# Altium schematic sheet ProbadorDeCables_Accesorios_A_CPC14.SchDoc
size A4
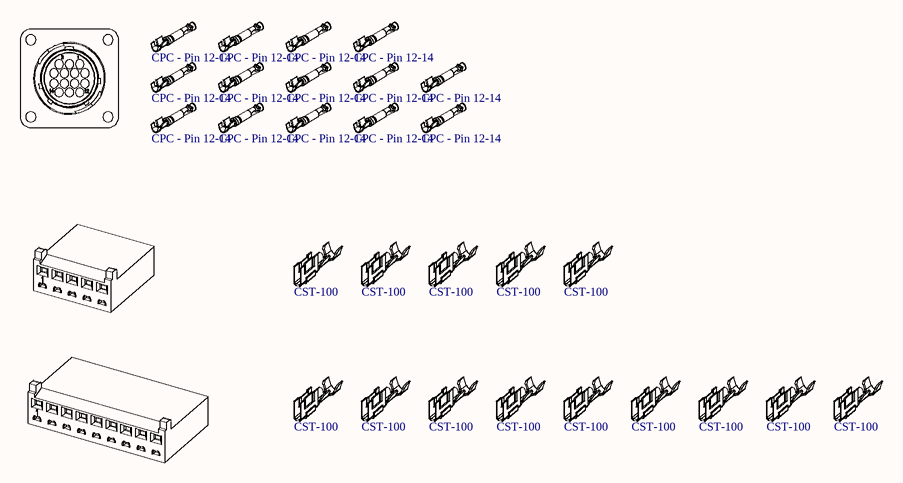
[diagram p0: ProbadorDeCables_Accesorios_A_CPC14.SchDoc]

## Parts
BOM_A30_A31  CPC14 Hembra  [BOM_CPC-14_Hembra]  (value not drawn)  (mechanical)
BOM_A30_A31__1  ParaHousing: CPC - Pin 12-14  [BOM_sock_CPC14_Hembra]  (hidden comment: sock_CPC-Hembra_66360-3)  (mechanical)
BOM_A30_A31__2  ParaHousing: CPC - Pin 12-14  [BOM_sock_CPC14_Hembra]  (hidden comment: sock_CPC-Hembra_66360-3)  (mechanical)
BOM_A30_A31__3  ParaHousing: CPC - Pin 12-14  [BOM_sock_CPC14_Hembra]  (hidden comment: sock_CPC-Hembra_66360-3)  (mechanical)
BOM_A30_A31__4  ParaHousing: CPC - Pin 12-14  [BOM_sock_CPC14_Hembra]  (hidden comment: sock_CPC-Hembra_66360-3)  (mechanical)
BOM_A30_A31__5  ParaHousing: CPC - Pin 12-14  [BOM_sock_CPC14_Hembra]  (hidden comment: sock_CPC-Hembra_66360-3)  (mechanical)
BOM_A30_A31__6  ParaHousing: CPC - Pin 12-14  [BOM_sock_CPC14_Hembra]  (hidden comment: sock_CPC-Hembra_66360-3)  (mechanical)
BOM_A30_A31__7  ParaHousing: CPC - Pin 12-14  [BOM_sock_CPC14_Hembra]  (hidden comment: sock_CPC-Hembra_66360-3)  (mechanical)
BOM_A30_A31__8  ParaHousing: CPC - Pin 12-14  [BOM_sock_CPC14_Hembra]  (hidden comment: sock_CPC-Hembra_66360-3)  (mechanical)
BOM_A30_A31__9  ParaHousing: CPC - Pin 12-14  [BOM_sock_CPC14_Hembra]  (hidden comment: sock_CPC-Hembra_66360-3)  (mechanical)
BOM_A30_A31__10  ParaHousing: CPC - Pin 12-14  [BOM_sock_CPC14_Hembra]  (hidden comment: sock_CPC-Hembra_66360-3)  (mechanical)
BOM_A30_A31__11  ParaHousing: CPC - Pin 12-14  [BOM_sock_CPC14_Hembra]  (hidden comment: sock_CPC-Hembra_66360-3)  (mechanical)
BOM_A30_A31__12  ParaHousing: CPC - Pin 12-14  [BOM_sock_CPC14_Hembra]  (hidden comment: sock_CPC-Hembra_66360-3)  (mechanical)
BOM_A30_A31__13  ParaHousing: CPC - Pin 12-14  [BOM_sock_CPC14_Hembra]  (hidden comment: sock_CPC-Hembra_66360-3)  (mechanical)
BOM_A30_A31__14  ParaHousing: CPC - Pin 12-14  [BOM_sock_CPC14_Hembra]  (hidden comment: sock_CPC-Hembra_66360-3)  (mechanical)
BOM_A30_A31__15  CST-100-5  [BOM_CST-100-5]  (value not drawn)  (mechanical)
BOM_A30_A31__16  CST-100-9  [BOM_CST-100-9]  (value not drawn)  (mechanical)
BOM_A30_A31__17  ParaHousing: CST-100  [BOM_sock_CST_1375819-1]  (hidden comment: sock_CST_1375819-1)  (mechanical)
BOM_A30_A31__18  ParaHousing: CST-100  [BOM_sock_CST_1375819-1]  (hidden comment: sock_CST_1375819-1)  (mechanical)
BOM_A30_A31__19  ParaHousing: CST-100  [BOM_sock_CST_1375819-1]  (hidden comment: sock_CST_1375819-1)  (mechanical)
BOM_A30_A31__20  ParaHousing: CST-100  [BOM_sock_CST_1375819-1]  (hidden comment: sock_CST_1375819-1)  (mechanical)
BOM_A30_A31__21  ParaHousing: CST-100  [BOM_sock_CST_1375819-1]  (hidden comment: sock_CST_1375819-1)  (mechanical)
BOM_A30_A31__22  ParaHousing: CST-100  [BOM_sock_CST_1375819-1]  (hidden comment: sock_CST_1375819-1)  (mechanical)
BOM_A30_A31__23  ParaHousing: CST-100  [BOM_sock_CST_1375819-1]  (hidden comment: sock_CST_1375819-1)  (mechanical)
BOM_A30_A31__24  ParaHousing: CST-100  [BOM_sock_CST_1375819-1]  (hidden comment: sock_CST_1375819-1)  (mechanical)
BOM_A30_A31__25  ParaHousing: CST-100  [BOM_sock_CST_1375819-1]  (hidden comment: sock_CST_1375819-1)  (mechanical)
BOM_A30_A31__26  ParaHousing: CST-100  [BOM_sock_CST_1375819-1]  (hidden comment: sock_CST_1375819-1)  (mechanical)
BOM_A30_A31__27  ParaHousing: CST-100  [BOM_sock_CST_1375819-1]  (hidden comment: sock_CST_1375819-1)  (mechanical)
BOM_A30_A31__28  ParaHousing: CST-100  [BOM_sock_CST_1375819-1]  (hidden comment: sock_CST_1375819-1)  (mechanical)
BOM_A30_A31__29  ParaHousing: CST-100  [BOM_sock_CST_1375819-1]  (hidden comment: sock_CST_1375819-1)  (mechanical)
BOM_A30_A31__30  ParaHousing: CST-100  [BOM_sock_CST_1375819-1]  (hidden comment: sock_CST_1375819-1)  (mechanical)

## Library data of the parts
BOM_A30_A31 = CPC14_Hembra: CONN RCPT HSG FMALE 14POS PNL MT; Cod.Fabricante: 206043-1; Fabricante: TE Connectivity AMP Connectors; Cod.DigiKey: A1362-ND; ComponentLink1Description: Manufacturer Link; ComponentLink1URL: https://www.te.com/commerce/DocumentDelivery/DDEController?Action=srchrtrv&DocNm=206043&DocType=Customer+Drawing&DocLang=English; DIGIKEYx50: 3.63720; DIGIKEYx100: 3.46400
BOM_A30_A31__1-BOM_A30_A31__14 = sock_CPC-Hembra_66360-3: CONN SOCKET 18-24AWG CRIMP TIN; Fabricante: TE Connectivity AMP Connectors; Cod.DigiKey: A25128-ND; Cod.Fabricante: 66360-3; ComponentLink1Description: Manufacturer Link; ComponentLink1URL: https://www.te.com/commerce/DocumentDelivery/DDEController?Action=srchrtrv&DocNm=66360&DocType=Customer+Drawing&DocLang=English; DIGIKEYx100: 0.99460; DIGIKEYx50: 1.03980
BOM_A30_A31__15 = CST-100-5: CONN RCPT HSNG 5POS CST-100 II; Cod.Fabricante: 1375820-5; Fabricante: TE Connectivity AMP Connectors; Cod.DigiKey: A99616-ND; ComponentLink1Description: Manufacturer Link; ComponentLink1URL: https://www.te.com/commerce/DocumentDelivery/DDEController?Action=srchrtrv&DocNm=1375820&DocType=Customer+Drawing&DocLang=English; DIGIKEYx50: 0.20980; DIGIKEYx100: 0.20160
BOM_A30_A31__16 = CST-100-9: CONN RCPT HSNG 9POS CST-100 II; Cod.Fabricante: 1375820-9; Fabricante: TE Connectivity AMP Connectors; Cod.DigiKey: A99619-ND; ComponentLink1Description: Manufacturer Link; ComponentLink1URL: https://www.te.com/commerce/DocumentDelivery/DDEController?Action=srchrtrv&DocNm=1375820&DocType=Customer+Drawing&DocLang=English; DIGIKEYx50: 0.35560; DIGIKEYx100: 0.34070
BOM_A30_A31__17-BOM_A30_A31__30 = sock_CST_1375819-1: CONN SOCKET 22-26AWG CRIMP TIN; Fabricante: TE Connectivity AMP Connectors; Cod.DigiKey: A100453CT-ND; Cod.Fabricante: 1375819-1; ComponentLink1Description: Manufacturer Link; ComponentLink1URL: https://www.te.com/commerce/DocumentDelivery/DDEController?Action=srchrtrv&DocNm=1375819&DocType=Customer+Drawing&DocLang=English; DIGIKEYx100: 0.04210; DIGIKEYx50: 0.03960